# EasyEDA Pro project URADORRY-SUN.eprj, board Main/Rev1.0
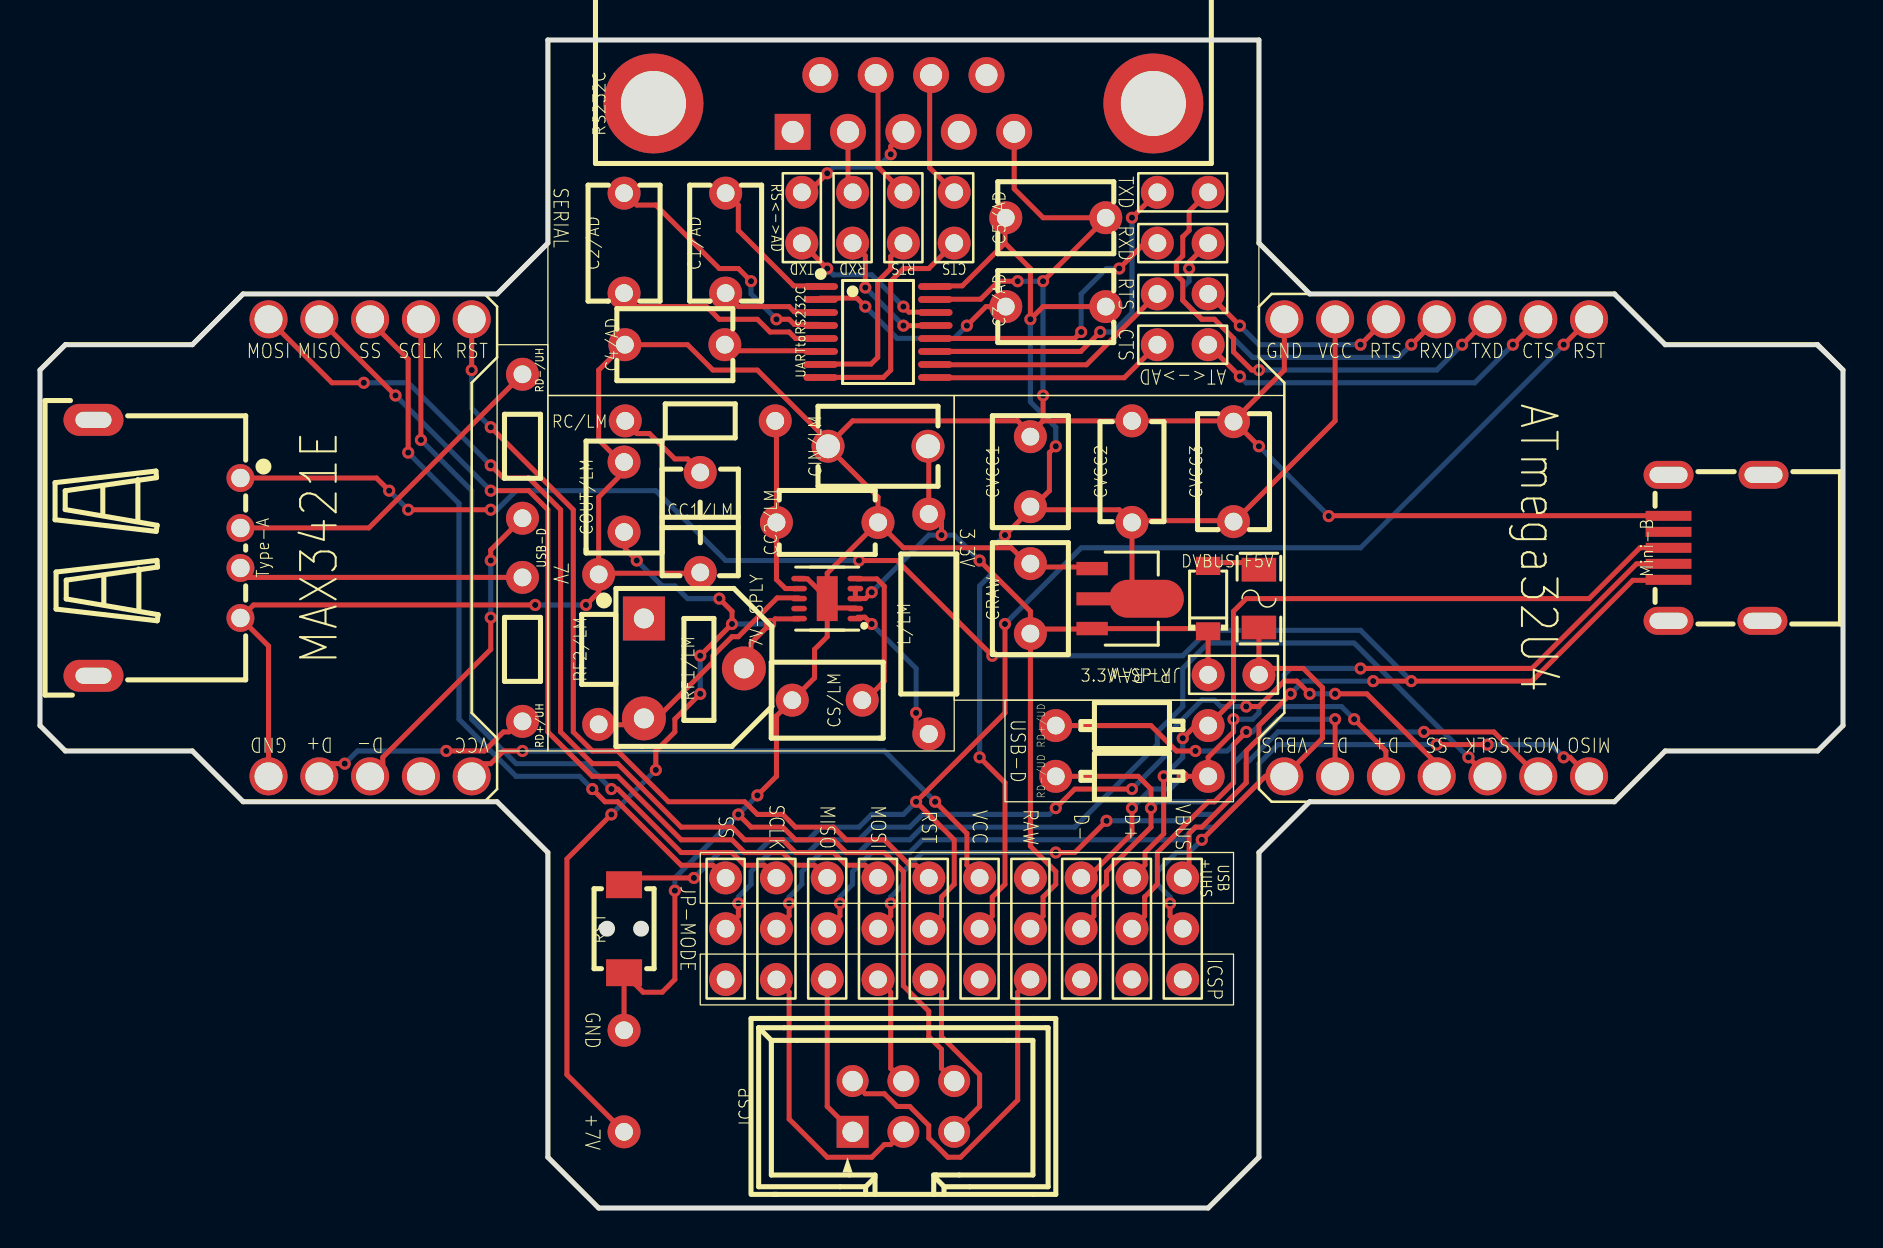
[diagram p6: board, top side]
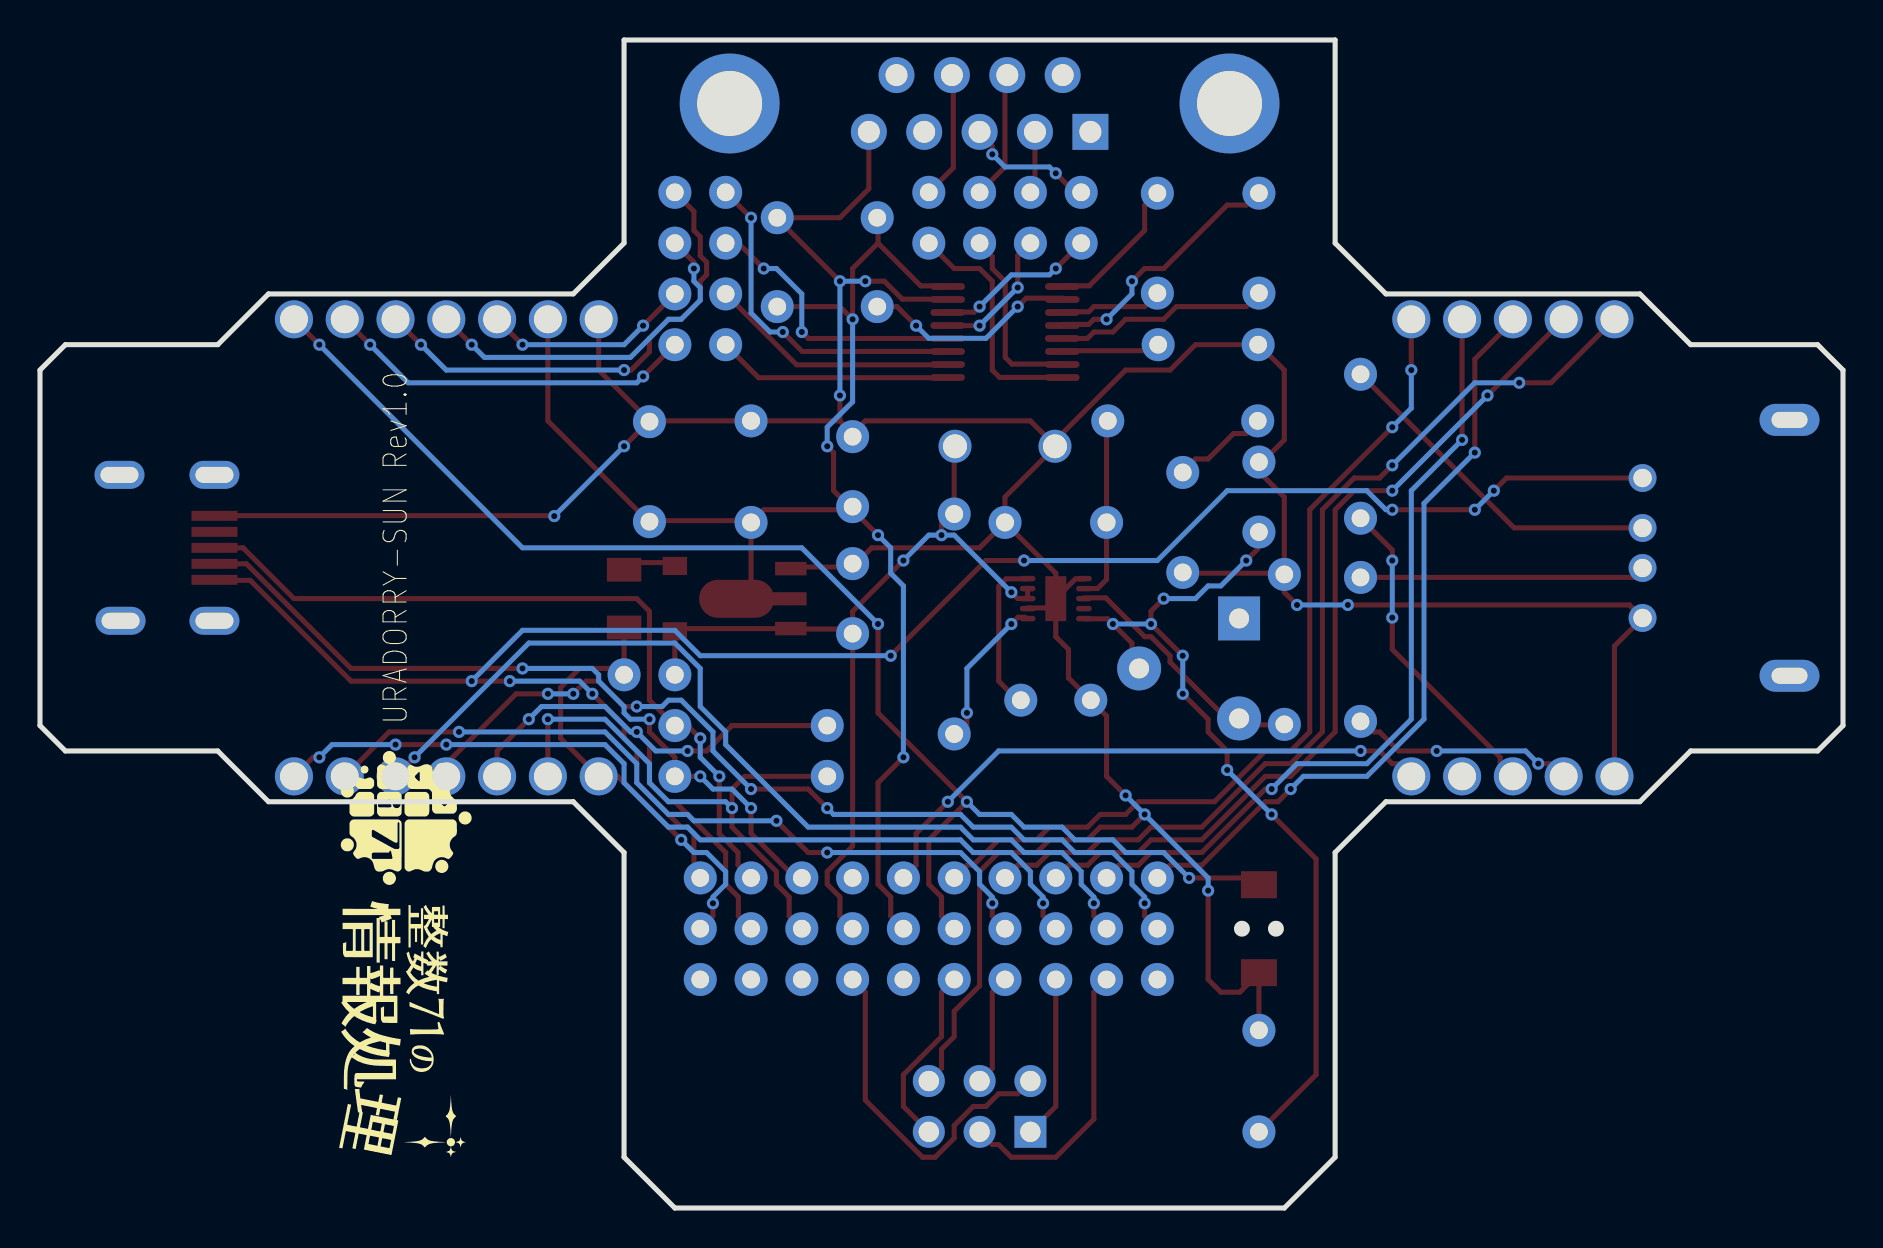
[diagram p7: board, bottom side, seen from below]

Outline 90.17 x 58.42 mm; copper layers: Top Layer, Bottom Layer. Coordinates in mm from the lower left corner of the outline.
Outline path: 0,41.91 1.27,43.18 7.62,43.18 10.16,45.72 22.86,45.72 25.4,48.26 25.4,58.42 60.96,58.42 60.96,48.26 63.5,45.72 78.74,45.72 81.28,43.18 88.9,43.18 90.17,41.91 90.17,24.13 88.9,22.86 81.28,22.86 78.74,20.32 63.5,20.32 60.96,17.78 60.96,2.54 58.42,0 27.94,0 25.4,2.54 25.4,17.78 22.86,20.32 10.16,20.32 7.62,22.86 1.27,22.86 0,24.13 0,41.91
Stack: Top Layer 0.035mm / Dielectric1 1.51mm FR4 er 4.5 / Bottom Layer 0.035mm

## Design rules (mm)
template: JLCPCB Capability(Two Layers Board)
spacing copperThickness1oz (default): track to track 0.102, other pairs 0.152 to 0.3
spacing copperThickness2oz: track to track 0.203, other pairs 0.152 to 0.3
track width copperThickness1oz (default): min 0.127, default 0.254, max 2.54
track width copperThickness2oz: min 0.203, default 0.254, max 2.54
differential pair differentialPair (default): width min 0.127, default 0.254, max 2.54; gap min 0.152, default 0.152
via viaSize (default): diameter min 0.5, default 0.61, max 10; hole min 0.3, default 0.305, max 6.3

## Placement (name value [footprint] x y rotation side)
3.3V-SPLY  AMS1117-3.3  [SOT-89-3L_L4.5-W2.5-P1.50-LS4.1-BR]  53.97 30.48 180 top
7V-SPLY  LM4510SD/NOPB  [VSON-10_L3.0-W3.0-P0.50-BL-EP-ADS8867IDRCR]  39.37 30.48 90 top
C1/AD  100nF  [cap-th_l5.8-w3.6-p5.0-d0.6]  34.29 48.26 90 top
C2/AD  100nF  [cap-th_l5.8-w3.6-p5.0-d0.6]  29.21 48.26 90 top
C3/AD  100nF  [cap-th_l5.8-w3.6-p5.0-d0.6]  50.8 45.09 180 top
C4/AD  100nF  [cap-th_l5.8-w3.6-p5.0-d0.6]  31.75 43.18 0 top
C5/AD  100nF  [cap-th_l5.8-w3.6-p5.0-d0.6]  50.8 49.53 0 top
CC1/LM  2.2nF  [cap-th_l5.0-w3.5-p5.00-d0.5]  33.02 34.29 270 top
CC2/LM  15pF  [cap-th_l4.8-w3.2-p5.08-d0.5]  39.37 34.29 0 top
CIN/LM  4.7uF  [cap-th_l6.0-w4.0-p5.00-d1.2]  41.91 38.1 180 top
COUT/LM  10uF  [cap-th_l5.5-w3.8-p3.50-d0.6]  29.21 35.56 90 top
CRAW  10uF  [cap-th_l5.5-w3.8-p3.50-d0.6]  49.53 30.48 90 top
CS/LM  10uF  [cap-th_l5.5-w3.8-p3.50-d0.6]  39.37 25.4 180 top
CVCC1  10uF  [cap-th_l5.5-w3.8-p3.50-d0.6]  49.53 36.83 90 top
CVCC2  1uF  [cap-th_l5.0-w3.2-p5.08-d0.6]  54.61 36.83 90 top
CVCC3  100nF  [cap-th_l5.8-w3.6-p5.0-d0.6]  59.69 36.83 90 top
DVBUS  MBR0540  [SOD-123_L2.7-W1.6-LS3.7-RD]  58.42 30.48 90 top
F5V  BSMD1206-150-16V  [F1206]  60.96 30.48 90 top
ICSP  FBH25401-D06S1001K6K  [IDC-TH_FBH25401-D06S1001K6K]  43.18 5.08 0 top
L/LM  4.7uH  [ind-th_bd2.8-l7.0-p11.00-d0.5]  44.45 29.21 270 top
Mini-B  GT-USB-2207  [USB-SMD_GT-USB-2207]  83.82 33.02 90 top
NOREF  -  [Pad_e108]  58.42 48.26 0 top
NOREF#2  -  [Pad_e168]  46.99 16.51 0 top
NOREF#3  -  [Pad_e162]  49.53 13.97 0 top
NOREF#4  -  [Pad_e195]  57.15 11.43 0 top
NOREF#5  -  [Pad_e657]  74.93 44.45 0 top
NOREF#6  -  [Pad_e655]  74.93 21.59 0 top
NOREF#7  -  [Pad_e157]  41.91 13.97 0 top
NOREF#8  -  [Pad_e924]  16.51 44.45 0 top
NOREF#9  -  [Pad_e854]  19.05 44.45 0 top
NOREF#10  -  [Pad_e146]  36.83 11.43 0 top
NOREF#11  -  [Pad_e113]  55.88 45.72 0 top
NOREF#12  -  [Pad_e448]  64.77 44.45 0 top
NOREF#13  -  [Pad_e193]  57.15 16.51 0 top
NOREF#14  -  [Pad_e122]  43.18 50.8 0 top
NOREF#15  -  [Pad_e170]  54.61 16.51 0 top
NOREF#16  -  [Pad_e3713]  29.21 3.81 0 top
NOREF#17  -  [Pad_e153]  54.61 11.43 0 top
NOREF#18  -  [Pad_e605]  72.39 44.45 0 top
NOREF#19  -  [Pad_e154]  34.29 13.97 0 top
NOREF#20  -  [Pad_e116]  40.64 50.8 0 top
NOREF#21  -  [Pad_e119]  45.72 48.26 0 top
NOREF#22  -  [Pad_e161]  54.61 13.97 0 top
NOREF#23  -  [Pad_e192]  57.15 13.97 0 top
NOREF#24  -  [Pad_e811]  21.59 21.59 0 top
NOREF#25  -  [Pad_e105]  55.88 48.26 0 top
NOREF#26  -  [Pad_e45]  58.42 26.67 0 top
NOREF#27  -  [Pad_e163]  34.29 16.51 0 top
NOREF#28  -  [Pad_e160]  52.07 13.97 0 top
NOREF#29  -  [Pad_e502]  67.31 21.59 0 top
NOREF#30  -  [Pad_e997]  13.97 44.45 0 top
NOREF#31  -  [Pad_e703]  77.47 21.59 0 top
NOREF#32  -  [Pad_e165]  39.37 16.51 0 top
NOREF#33  -  [Pad_e159]  46.99 13.97 0 top
NOREF#34  -  [Pad_e1001]  13.97 21.59 0 top
NOREF#35  -  [Pad_e167]  44.45 16.51 0 top
NOREF#36  -  [Pad_e169]  52.07 16.51 0 top
NOREF#37  -  [Pad_e1062]  11.43 21.59 0 top
NOREF#38  -  [Pad_e144]  34.29 11.43 0 top
NOREF#39  -  [Pad_e404]  62.23 21.59 0 top
NOREF#40  -  [Pad_e112]  58.42 43.18 0 top
NOREF#41  -  [Pad_e810]  21.59 44.45 0 top
NOREF#42  -  [Pad_e149]  44.45 11.43 0 top
NOREF#43  -  [Pad_e557]  69.85 44.45 0 top
NOREF#44  -  [Pad_e147]  39.37 11.43 0 top
NOREF#45  -  [Pad_e171]  49.53 16.51 0 top
NOREF#46  -  [Pad_e166]  41.91 16.51 0 top
NOREF#47  -  [Pad_e120]  45.72 50.8 0 top
NOREF#48  -  [Pad_e452]  64.77 21.59 0 top
NOREF#49  -  [Pad_e158]  44.45 13.97 0 top
NOREF#50  -  [Pad_e114]  58.42 45.72 0 top
NOREF#51  -  [Pad_e155]  36.83 13.97 0 top
NOREF#52  -  [Pad_e705]  77.47 44.45 0 top
NOREF#53  -  [Pad_e405]  62.23 44.45 0 top
NOREF#54  -  [Pad_e121]  43.18 48.26 0 top
NOREF#55  -  [Pad_e857]  19.05 21.59 0 top
NOREF#56  -  [Pad_e110]  58.42 50.8 0 top
NOREF#57  -  [Pad_e559]  69.85 21.59 0 top
NOREF#58  -  [Pad_e111]  55.88 43.18 0 top
NOREF#59  -  [Pad_e500]  67.31 44.45 0 top
NOREF#60  -  [Pad_e109]  55.88 50.8 0 top
NOREF#61  -  [Pad_e603]  72.39 21.59 0 top
NOREF#62  -  [Pad_e117]  38.1 48.26 0 top
NOREF#63  -  [Pad_e40]  60.96 26.67 0 top
NOREF#64  -  [Pad_e151]  49.53 11.43 0 top
NOREF#65  -  [Pad_e3708]  29.21 8.89 0 top
NOREF#66  -  [Pad_e164]  36.83 16.51 0 top
NOREF#67  -  [Pad_e922]  16.51 21.59 0 top
NOREF#68  -  [Pad_e152]  52.07 11.43 0 top
NOREF#69  -  [Pad_e148]  41.91 11.43 0 top
NOREF#70  -  [Pad_e156]  39.37 13.97 0 top
NOREF#71  -  [Pad_e115]  40.64 48.26 0 top
NOREF#72  -  [Pad_e118]  38.1 50.8 0 top
NOREF#73  -  [Pad_e1060]  11.43 44.45 0 top
NOREF#74  -  [Pad_e150]  46.99 11.43 0 top
RC/LM  47kΩ  [res-th_bd1.7-l3.5-p7.50-d0.5]  33.02 39.37 180 top
RD+/UD  22Ω  [res-th_bd2.3-l3.7-p7.70-d0.9]  54.61 24.13 0 top
RD+/UH  33Ω  [res-th_bd1.8-l3.2-p7.20-d0.4]  24.13 27.94 90 top
RD-/UD  22Ω  [res-th_bd2.3-l3.7-p7.70-d0.9]  54.61 21.59 0 top
RD-/UH  33Ω  [res-th_bd1.8-l3.2-p7.20-d0.4]  24.13 38.1 90 top
RF1/LM  100kΩ  [RES-ADJ-SMD_RM065-V1]  32.7 26.99 270 top
RF2/LM  20kΩ  [res-th_bd1.7-l3.5-p7.50-d0.5]  27.94 27.94 90 top
RS232C  D-SUB-DR-9PCM-CB  [DB9-TH_ID09S33E4GV00LF]  43.18 55.25 180 top
RST  YTSA010A0201803B  [SW-SMD_L4.0-W3.0-LS5.0-EH]  29.21 13.97 90 top
Type-A  KH-AF90QC-10-H6.3  [USB-A-TH_KINGHELM_KH-AF90QC-10-H6.3]  6.35 33.02 270 top
UARTtoRS232C  ADM3202ARUZ-REEL7  [TSSOP-16_L5.0-W4.4-P0.65-LS6.4-BL]  41.91 43.82 270 top

## Footprints (pads in the part's own frame, mm; a bottom-side part is the same pattern mirrored in y, then rotated)
cap-th_l4.8-w3.2-p5.08-d0.5
  round 1.651 hole 0.9x0.889: 1(-2.54,0) 2(2.54,0)
cap-th_l5.0-w3.2-p5.08-d0.6
  round 1.651 hole 0.9x0.889: 1(-2.54,0) 2(2.54,0)
cap-th_l5.0-w3.5-p5.00-d0.5
  round 1.651 hole 0.889: 1(-2.5,0) 2(2.5,0)
cap-th_l5.5-w3.8-p3.50-d0.6
  round 1.651 hole 0.889: 1(-1.75,0) 2(1.75,0)
cap-th_l5.8-w3.6-p5.0-d0.6
  round 1.651 hole 0.889: 1(-2.5,0) 2(2.5,0)
cap-th_l6.0-w4.0-p5.00-d1.2
  round 1.651 hole 1.2x0.889: 1(-2.5,0) 2(2.5,0)
DB9-TH_ID09S33E4GV00LF
  rect 1.8x1.8 hole 1.1: 1(5.54,1.42)
  round 1.8 hole 1.1: 2(2.77,1.42) 3(0,1.42) 4(-2.77,1.42) 5(-5.54,1.42) 6(4.155,-1.42) 7(1.385,-1.42) 8(-1.385,-1.42) 9(-4.155,-1.42)
  round 5 hole 3.25: 10(-12.5,0) 11(12.5,0)
F1206
  rect 1.19x1.728 smd: 1(-1.445,0) 2(1.445,0)
IDC-TH_FBH25401-D06S1001K6K
  rect 1.6x1.6 hole 1.02: 1(-2.54,-1.27)
  round 1.6 hole 1.02: 2(-2.54,1.27) 3(0,-1.27) 4(0,1.27) 5(2.54,-1.27) 6(2.54,1.27)
ind-th_bd2.8-l7.0-p11.00-d0.5
  round 1.651 hole 0.9x0.889: 1(-5.5,0) 2(5.5,0)
Pad_e40
  round 1.651 hole 0.889: 1(0,0)
Pad_e45
  round 1.651 hole 0.889: 1(0,0)
Pad_e105
  round 1.651 hole 0.889: 2(0,0)
Pad_e108
  round 1.651 hole 0.889: 2(0,0)
Pad_e109
  round 1.651 hole 0.889: 2(0,0)
Pad_e110
  round 1.651 hole 0.889: 2(0,0)
Pad_e111
  round 1.651 hole 0.889: 2(0,0)
Pad_e112
  round 1.651 hole 0.889: 2(0,0)
Pad_e113
  round 1.651 hole 0.889: 2(0,0)
Pad_e114
  round 1.651 hole 0.889: 2(0,0)
Pad_e115
  round 1.651 hole 0.889: 2(0,0)
Pad_e116
  round 1.651 hole 0.889: 2(0,0)
Pad_e117
  round 1.651 hole 0.889: 2(0,0)
Pad_e118
  round 1.651 hole 0.889: 2(0,0)
Pad_e119
  round 1.651 hole 0.889: 2(0,0)
Pad_e120
  round 1.651 hole 0.889: 2(0,0)
Pad_e121
  round 1.651 hole 0.889: 2(0,0)
Pad_e122
  round 1.651 hole 0.889: 2(0,0)
Pad_e144
  round 1.651 hole 0.889: 3(0,0)
Pad_e146
  round 1.651 hole 0.889: 3(0,0)
Pad_e147
  round 1.651 hole 0.889: 3(0,0)
Pad_e148
  round 1.651 hole 0.889: 3(0,0)
Pad_e149
  round 1.651 hole 0.889: 3(0,0)
Pad_e150
  round 1.651 hole 0.889: 3(0,0)
Pad_e151
  round 1.651 hole 0.889: 3(0,0)
Pad_e152
  round 1.651 hole 0.889: 3(0,0)
Pad_e153
  round 1.651 hole 0.889: 3(0,0)
Pad_e154
  round 1.651 hole 0.889: 3(0,0)
Pad_e155
  round 1.651 hole 0.889: 3(0,0)
Pad_e156
  round 1.651 hole 0.889: 3(0,0)
Pad_e157
  round 1.651 hole 0.889: 3(0,0)
Pad_e158
  round 1.651 hole 0.889: 3(0,0)
Pad_e159
  round 1.651 hole 0.889: 3(0,0)
Pad_e160
  round 1.651 hole 0.889: 3(0,0)
Pad_e161
  round 1.651 hole 0.889: 3(0,0)
Pad_e162
  round 1.651 hole 0.889: 3(0,0)
Pad_e163
  round 1.651 hole 0.889: 3(0,0)
Pad_e164
  round 1.651 hole 0.889: 3(0,0)
Pad_e165
  round 1.651 hole 0.889: 3(0,0)
Pad_e166
  round 1.651 hole 0.889: 3(0,0)
Pad_e167
  round 1.651 hole 0.889: 3(0,0)
Pad_e168
  round 1.651 hole 0.889: 3(0,0)
Pad_e169
  round 1.651 hole 0.889: 3(0,0)
Pad_e170
  round 1.651 hole 0.889: 3(0,0)
Pad_e171
  round 1.651 hole 0.889: 3(0,0)
Pad_e192
  round 1.651 hole 0.889: 3(0,0)
Pad_e193
  round 1.651 hole 0.889: 3(0,0)
Pad_e195
  round 1.651 hole 0.889: 3(0,0)
Pad_e404
  round 1.905 hole 1.397: 1(0,0)
Pad_e405
  round 1.905 hole 1.397: 1(0,0)
Pad_e448
  round 1.905 hole 1.397: 1(0,0)
Pad_e452
  round 1.905 hole 1.397: 1(0,0)
Pad_e500
  round 1.905 hole 1.397: 1(0,0)
Pad_e502
  round 1.905 hole 1.397: 1(0,0)
Pad_e557
  round 1.905 hole 1.397: 1(0,0)
Pad_e559
  round 1.905 hole 1.397: 1(0,0)
Pad_e603
  round 1.905 hole 1.397: 1(0,0)
Pad_e605
  round 1.905 hole 1.397: 1(0,0)
Pad_e655
  round 1.905 hole 1.397: 1(0,0)
Pad_e657
  round 1.905 hole 1.397: 1(0,0)
Pad_e703
  round 1.905 hole 1.397: 1(0,0)
Pad_e705
  round 1.905 hole 1.397: 1(0,0)
Pad_e810
  round 1.905 hole 1.397: 1(0,0)
Pad_e811
  round 1.905 hole 1.397: 1(0,0)
Pad_e854
  round 1.905 hole 1.397: 1(0,0)
Pad_e857
  round 1.905 hole 1.397: 1(0,0)
Pad_e922
  round 1.905 hole 1.397: 1(0,0)
Pad_e924
  round 1.905 hole 1.397: 1(0,0)
Pad_e997
  round 1.905 hole 1.397: 1(0,0)
Pad_e1001
  round 1.905 hole 1.397: 1(0,0)
Pad_e1060
  round 1.905 hole 1.397: 1(0,0)
Pad_e1062
  round 1.905 hole 1.397: 1(0,0)
Pad_e3708
  round 1.651 hole 0.889: 4(0,0)
Pad_e3713
  round 1.651 hole 0.889: 5(0,0)
RES-ADJ-SMD_RM065-V1
  rect 2.2x2.1 hole 1: 1(-2.5,-2.5)
  round 2.2 hole 1: 2(0,2.5) 3(2.5,-2.5)
res-th_bd1.7-l3.5-p7.50-d0.5
  round 1.651 hole 0.889: 1(-3.75,0) 2(3.75,0)
res-th_bd1.8-l3.2-p7.20-d0.4
  round 1.651 hole 0.889: 1(-3.6,0) 2(3.6,0)
res-th_bd2.3-l3.7-p7.70-d0.9
  round 1.651 hole 0.889: 1(-3.81,0) 2(3.81,0)
SOD-123_L2.7-W1.6-LS3.7-RD
  rect 0.91x1.22 smd: 1(-1.635,0) 2(1.635,0)
SOT-89-3L_L4.5-W2.5-P1.50-LS4.1-BR
  rect 1.575x0.672 smd: 1(1.356,-1.5) 3(1.356,1.5)
  custom 5.377x1.9 smd: 2(-1.356,0.009)
SW-SMD_L4.0-W3.0-LS5.0-EH
  rect 1.35x1.8 smd: 1(-2.2,0) 2(2.2,0)
TSSOP-16_L5.0-W4.4-P0.65-LS6.4-BL
  oval 0.343x1.732 smd: 1(-2.275,-2.866) 2(-1.625,-2.866) 3(-0.975,-2.866) 4(-0.325,-2.866) 5(0.325,-2.866) 6(0.975,-2.866) 7(1.625,-2.866) 8(2.275,-2.866) 9(2.275,2.866) 10(1.625,2.866) 11(0.975,2.866) 12(0.325,2.866) 13(-0.325,2.866) 14(-0.975,2.866) 15(-1.625,2.866) 16(-2.275,2.866)
USB-A-TH_KINGHELM_KH-AF90QC-10-H6.3
  round 1.4 hole 0.92: 1(-3.491,3.675) 2(-0.992,3.675) 3(1.008,3.675) 4(3.509,3.675)
  oval 1.6x3 hole 0.8x1.8: 5(-6.4,-3.675) 6(6.4,-3.675)
USB-SMD_GT-USB-2207
  rect 0.5x2.3 smd: 1(-1.6,2.375) 2(-0.8,2.375) 3(0,2.375) 4(0.8,2.375) 5(1.6,2.375)
  oval 1.4x2.5 hole 0.8x1.9: 6(-3.65,2.375) 7(3.65,2.375) 8(-3.65,-2.321) 9(3.65,-2.375)
VSON-10_L3.0-W3.0-P0.50-BL-EP-ADS8867IDRCR
  oval 0.28x0.787 smd: 1(-1,-1.407) 2(-0.5,-1.407) 3(0,-1.407) 4(0.5,-1.407) 5(1,-1.407) 6(1,1.407) 7(0.5,1.407) 8(0,1.407) 9(-0.5,1.407) 10(-1,1.407)
  rect 2.25x1.05 smd: 11(0,0)

## Nets
+3.3V: 3.3V-SPLY.2 C3/AD.1 C5/AD.1 CVCC1.1 CVCC2.1 CVCC3.1 NOREF#12.1 NOREF#33.3 UARTtoRS232C.16
+5V: F5V.1 NOREF#23.3 NOREF#39.1 NOREF#63.1
+5V-SAT: DVBUS.2 F5V.2
+7V: 7V-SPLY.10 COUT/LM.1 NOREF#16.5 RF1/LM.2
GND: 3.3V-SPLY.1 7V-SPLY.2 7V-SPLY.6 7V-SPLY.11 C4/AD.1 C5/AD.2 CC1/LM.2 CC2/LM.2 CIN/LM.2 COUT/LM.2 CRAW.2 CS/LM.2 CVCC1.2 CVCC2.2 CVCC3.2 ICSP.6 Mini-B.5 NOREF#37.1 NOREF#53.1 NOREF#65.4 RF2/LM.2 RS232C.5 RST.1 Type-A.4 UARTtoRS232C.15
+3.3V/MX: NOREF#2.3 NOREF#24.1
+5V/U: Mini-B.1 NOREF#13.3 Type-A.1
C1+/AD: C1/AD.2 UARTtoRS232C.1
C1-/AD: C1/AD.1 UARTtoRS232C.3
C2+/AD: C2/AD.2 UARTtoRS232C.4
C2-/AD: C2/AD.1 UARTtoRS232C.5
COMP1/LM: CC1/LM.1 RC/LM.2
COMP/LM: 7V-SPLY.7 CC2/LM.1 RC/LM.1
CTS-AT/AD: NOREF#58.2 UARTtoRS232C.9
CTS-RS/AD: NOREF#21.2 UARTtoRS232C.8
CTS/AT: NOREF#5.1 NOREF#40.2
CTS/RS: NOREF#47.2 RS232C.8
D+/AT: NOREF#22.3 NOREF#29.1 RD+/UD.1
D+/MX: NOREF#34.1 RD+/UH.1
D+/UD: Mini-B.3 NOREF#15.3 RD+/UD.2
D+/UH: RD+/UH.2 Type-A.3
D-/AT: NOREF#28.3 NOREF#48.1 RD-/UD.1
D-/MX: NOREF#67.1 RD-/UH.1
D-/UD: Mini-B.2 NOREF#36.3 RD-/UD.2
D-/UH: RD-/UH.2 Type-A.2
DCD/RS: RS232C.1
DSR/RS: RS232C.6
DTR/RS: RS232C.4
FB/LM: 7V-SPLY.8 RF1/LM.3 RF2/LM.1
MISO/AT: NOREF#31.1 NOREF#70.3
MISO/IC: ICSP.1 NOREF#44.3
MISO/MX: NOREF#30.1 NOREF#32.3
MOSI/AT: NOREF#6.1 NOREF#7.3
MOSI/IC: ICSP.4 NOREF#69.3
MOSI/MX: NOREF#46.3 NOREF#73.1
RAW: 3.3V-SPLY.3 7V-SPLY.3 7V-SPLY.4 CIN/LM.1 CRAW.1 DVBUS.1 L/LM.1 NOREF#3.3 NOREF#26.1
RAW/IC: ICSP.2 NOREF#64.3
RING/RS: RS232C.9
RST: NOREF#49.3 NOREF#52.1 RST.2
RST/IC: ICSP.5 NOREF#42.3
RST/MX: NOREF#35.3 NOREF#41.1
RTS-AT/AD: NOREF#11.2 UARTtoRS232C.10
RTS-RS/AD: NOREF#54.2 UARTtoRS232C.7
RTS/AT: NOREF#50.2 NOREF#59.1
RTS/RS: NOREF#14.2 RS232C.7
RXD-AT/AD: NOREF#25.2 UARTtoRS232C.12
RXD-RS/AD: NOREF#71.2 UARTtoRS232C.13
RXD/AT: NOREF.2 NOREF#43.1
RXD/RS: NOREF#20.2 RS232C.2
SCLK/AT: NOREF#51.3 NOREF#61.1
SCLK/IC: ICSP.3 NOREF#10.3
SCLK/MX: NOREF#9.1 NOREF#66.3
SS/AT: NOREF#19.3 NOREF#57.1
SS/LM: 7V-SPLY.5 CS/LM.1
SS/MX: NOREF#8.1 NOREF#27.3
SW/LM: 7V-SPLY.1 L/LM.2
TXD-AT/AD: NOREF#60.2 UARTtoRS232C.11
TXD-RS/AD: NOREF#62.2 UARTtoRS232C.14
TXD/AT: NOREF#18.1 NOREF#56.2
TXD/RS: NOREF#72.2 RS232C.3
V+/AD: C3/AD.2 UARTtoRS232C.2
V-/AD: C4/AD.2 UARTtoRS232C.6

Pads without a net: 7V-SPLY 9; Mini-B 4 6 7 8 9; NOREF#4 3; NOREF#17 3; NOREF#38 3; NOREF#45 3; NOREF#55 1; NOREF#68 3; NOREF#74 3; RF1/LM 1; RS232C 10 11; Type-A 5 6

## Via types
v1: diameter 0.61, hole 0.305, Top Layer to Bottom Layer, 106 vias

## Routing (per net, layer and track width the routed paths; a pad name or vN(x,y) marks a point on that pad's centre or on a via; arc(x,y) is an arc through that point)
+3.3V: length 74.5
  Top Layer w0.254: v1(46.99,22.54) 48.26,21.27 48.26,16.19 47.62,15.56 47.62,14.61 NOREF#33.3 ; 48.26,48.26 49.53,46.99 v1(49.53,44.45) 50.17,45.09 53.34,45.09 ; 48.26,48.26 48.26,49.53 ; 48.26,48.26 46.12,46.12 44.83,46.12 ; CVCC2.1 53.97,34.93 49.53,34.93 ; CVCC2.1 54.61,31.12 55.25,30.48 ; CVCC2.1 54.66,34.34 54.66,34.38 59.65,34.38 59.69,34.34 ; 49.53,34.93 50.48,35.88 50.48,37.78 v1(50.8,38.1) ; 49.53,34.93 v1(48.26,33.66) ; 59.69,34.29 64.77,39.37 NOREF#12.1
  Bottom Layer w0.254: v1(49.53,44.45) 49.53,40.32 50.8,39.05 v1(50.8,38.1) ; v1(46.99,22.54) 46.99,31.12 47.62,31.75 47.62,33.02 v1(48.26,33.66)
+5V: length 23.2
  Top Layer w0.254: v1(58.1,18.42) 61.28,21.59 NOREF#39.1 64.14,23.5 64.14,26.04 63.18,26.99 61.28,26.99 NOREF#63.1 60.96,29.21 ; v1(56.52,15.24) 56.52,14.61 NOREF#23.3
  Bottom Layer w0.254: v1(56.52,15.24) 56.52,15.56 55.88,16.19 55.88,16.83 56.83,17.78 57.47,17.78 v1(58.1,18.42)
+5V-SAT: length 2.8
  Top Layer w0.254: 58.38,32.28 60.43,32.28 60.96,31.75
+7V: length 44
  Top Layer w0.254: 35.23,27.12 35.56,27.45 35.56,28.26 v1(36.51,29.21) 36.77,29.47 37.93,29.47 ; v1(33.02,27.62) v1(34.61,29.21) 34.61,29.85 v1(33.97,30.48) ; v1(29.84,32.39) 29.28,32.95 29.28,33.69 ; v1(30.8,21.91) 30.8,22.86 31.75,23.81 31.75,24.45 v1(33.02,25.72) ; v1(28.58,19.69) 26.35,17.46 26.35,6.67 NOREF#16.5
  Bottom Layer w0.254: v1(36.51,29.21) v1(34.61,29.21) ; v1(30.8,21.91) v1(28.58,19.69) ; v1(33.97,30.48) 32.39,30.48 31.75,31.12 31.12,31.12 v1(29.84,32.39) ; v1(33.02,25.72) v1(33.02,27.62)
GND: length 208.2
  Top Layer w0.254: v1(34.93,19.69) 35.56,19.05 37.15,19.05 37.78,18.42 39.69,18.42 40.32,17.78 42.23,17.78 43.18,16.83 43.18,11.11 44.45,9.84 44.45,8.57 45.09,7.94 45.09,6.99 ICSP.6 ; 7V-SPLY.11 38.39,31.47 37.97,31.47 ; 7V-SPLY.11 39.37,31.75 CC2/LM.2 ; 7V-SPLY.11 39.84,30.02 40.78,30.02 ; 7V-SPLY.11 39.37,28.58 38.74,27.94 38.74,26.52 CS/LM.2 36.83,24.61 36.83,21.59 v1(35.88,20.64) ; v1(31.75,15.88) 31.75,11.43 31.12,10.8 30.16,10.8 29.21,11.75 ; CC2/LM.2 41.91,35.56 39.37,38.1 ; CC2/LM.2 43.18,33.02 48.58,33.02 49.21,32.39 49.53,32.39 49.85,32.06 52.64,32.06 ; NOREF#65.4 29.21,11.43 ; 33.02,31.75 27.94,31.75 ; 27.94,31.75 27.94,30.8 v1(27.31,30.16) ; 27.94,31.75 27.94,35.56 29.21,36.83 ; 39.37,38.1 39.37,38.42 35.88,41.91 33.66,41.91 32.39,43.18 29.4,43.18 29.3,43.28 ; 39.37,38.1 40.64,39.37 48.9,39.37 49.53,38.74 50.17,39.37 ; 10.03,29.51 11.43,28.11 NOREF#37.1 ; 10.03,29.51 10.01,29.49 ; 10.03,29.51 9.98,29.55 ; 10.03,29.51 10.68,30.16 v1(24.77,30.16) ; 81.44,34.63 64.47,34.63 v1(64.45,34.61) ; 50.17,39.37 CVCC2.2 59.69,39.37 ; 50.17,39.37 v1(50.17,40.64) ; NOREF#53.1 62.23,41.91 59.69,39.37 ; v1(50.17,46.36) 53.34,49.53 ; RS232C.5 48.72,50.98 50.17,49.53 C5/AD.2 ; v1(48.9,46.36) 47.94,46.36 47.04,45.46 44.82,45.46 ; 29.21,43.18 27.94,41.91 27.94,38.42 28.89,37.47 29.21,37.47 ; 59.69,39.37 v1(60.96,38.1)
  Bottom Layer w0.254: v1(35.88,20.64) v1(34.93,19.69) 31.75,16.51 v1(31.75,15.88) ; v1(64.45,34.61) v1(60.96,38.1) ; v1(48.9,46.36) v1(50.17,46.36) v1(50.17,40.64) ; v1(24.77,30.16) v1(27.31,30.16)
+3.3V/MX: length 29.5
  Top Layer w0.254: v1(24.13,22.86) 23.18,22.86 22.54,22.23 22.14,22.23 21.59,21.67 ; v1(44.77,20.32) 46.36,18.73 46.36,17.15 NOREF#2.3
  Bottom Layer w0.254: v1(24.13,22.86) 42.23,22.86 v1(44.77,20.32)
+5V/U: length 97.6
  Top Layer w0.254: v1(47.62,27.62) 42.86,32.39 v1(40.96,32.39) ; v1(66.68,26.35) v1(68.58,26.35) 74.61,26.35 79.65,31.39 81.53,31.39 ; Type-A.1 16.83,36.51 v1(17.46,35.88) ; v1(62.55,25.72) 60.96,24.13 60.96,23.5 60.33,22.86 60.33,21.27 58.1,19.05 57.78,19.05 57.47,18.73 57.47,16.83 NOREF#13.3 ; v1(22.54,34.93) v1(18.42,34.93)
  Bottom Layer w0.254: v1(66.68,26.35) 63.18,26.35 v1(62.55,25.72) ; v1(68.58,26.35) 66.04,28.89 58.42,28.89 57.15,27.62 v1(47.62,27.62) ; v1(22.54,34.93) 22.86,34.93 23.81,35.88 30.8,35.88 34.29,32.39 v1(40.96,32.39) ; v1(17.46,35.88) v1(18.42,34.93)
C1+/AD: length 7.5
  Top Layer w0.254: 34.29,50.8 34.93,50.17 34.93,48.9 37.7,46.12 39.06,46.12
C1-/AD: length 5.1
  Top Layer w0.254: 38.99,44.82 37.73,44.82 37.47,45.09 34.93,45.09 34.29,45.72
C2+/AD: length 12.9
  Top Layer w0.254: 29.21,50.8 29.84,50.17 30.8,50.17 33.97,46.99 34.93,46.99 v1(35.56,46.36) ; v1(36.83,44.45) 37.47,44.45 37.72,44.19 39.01,44.19
  Bottom Layer w0.254: v1(36.83,44.45) 35.56,45.72 v1(35.56,46.36)
C2-/AD: length 10.6
  Top Layer w0.254: 38.88,43.49 37.79,43.49 37.47,43.82 36.51,43.82 35.88,44.45 33.97,44.45 33.34,45.09 29.84,45.09 29.21,45.72
COMP1/LM: length 4.9
  Top Layer w0.254: 29.21,39.37 29.84,38.74 30.48,38.74 31.75,37.47 32.39,37.47 33.02,36.83
COMP/LM: length 9.2
  Top Layer w0.254: 37.91,30.98 37.28,30.98 36.83,31.43 CC2/LM.1 36.83,39.37
CTS-AT/AD: length 11.8
  Top Layer w0.254: 44.76,41.53 54.23,41.53 NOREF#58.2
CTS-RS/AD: length 12
  Top Layer w0.254: NOREF#21.2 44.45,46.99 43.18,46.99 42.55,46.36 42.55,41.91 42.18,41.54 39.13,41.54
CTS/AT: length 18.6
  Top Layer w0.254: v1(60.01,41.59) NOREF#40.2 ; NOREF#5.1 v1(73.66,43.18)
  Bottom Layer w0.254: v1(73.66,43.18) 71.75,41.28 60.33,41.28 v1(60.01,41.59)
CTS/RS: length 6.3
  Top Layer w0.254: NOREF#47.2 44.49,52.03 44.49,56.6
D+/AT: length 32.5
  Top Layer w0.254: NOREF#29.1 67.31,22.86 v1(65.72,24.45) ; v1(60.33,23.81) 59.69,23.18 59.69,21.27 58.74,20.32 58.42,20.32 55.88,17.78 55.88,16.19 55.25,15.56 55.25,14.61 NOREF#22.3 ; v1(57.78,22.86) 56.83,22.86 55.56,24.13 RD+/UD.1
  Bottom Layer w0.254: v1(65.72,24.45) 65.09,25.08 61.91,25.08 60.64,23.81 v1(60.33,23.81) 59.37,22.86 v1(57.78,22.86)
D+/MX: length 11.2
  Top Layer w0.254: v1(15.24,22.23) 14.61,22.23 NOREF#34.1 ; v1(20.32,22.86) 22.22,22.86 23.18,23.81 23.45,23.81 23.98,24.34
  Bottom Layer w0.254: v1(20.32,22.86) 15.88,22.86 v1(15.24,22.23)
D+/UD: length 38.7
  Top Layer w0.254: 81.28,33.02 80.01,33.02 77.47,30.48 60.33,30.48 59.69,29.85 59.69,25.4 RD+/UD.2 57.78,24.13 v1(57.15,23.5) ; v1(56.2,21.59) 56.2,18.72 55.26,17.78 55.26,17.16 NOREF#15.3
  Bottom Layer w0.254: v1(57.15,23.5) 57.15,22.54 v1(56.2,21.59)
D+/UH: length 14.3
  Top Layer w0.254: 10.04,31.94 10.44,31.54 RD+/UH.2
D-/AT: length 27.9
  Top Layer w0.254: NOREF#48.1 v1(64.77,24.45) ; RD-/UD.1 54.93,21.59 55.56,20.96 v1(55.56,20) 55.56,19.05 53.34,16.83 53.34,16.19 52.71,15.56 52.71,14.61 NOREF#28.3
  Bottom Layer w0.254: v1(64.77,24.45) 61.91,24.45 59.69,22.23 59.69,21.27 58.74,20.32 55.88,20.32 v1(55.56,20)
D-/MX: length 16.1
  Top Layer w0.254: NOREF#67.1 17.15,22.23 17.15,22.54 22.54,27.94 v1(22.54,29.53) ; RD-/UH.1 22.54,32.91 v1(22.54,32.39)
  Bottom Layer w0.254: v1(22.54,32.39) v1(22.54,29.53)
D-/UD: length 37.9
  Top Layer w0.254: v1(54.61,20) 54.61,18.73 52.39,16.51 NOREF#36.3 ; v1(57.15,21.59) RD-/UD.2 58.42,22.54 59.69,23.81 v1(59.69,24.45) ; v1(66.04,26.99) 74.61,26.99 79.84,32.22 Mini-B.2
  Bottom Layer w0.254: v1(66.04,26.99) 62.55,26.99 62.23,26.67 62.23,26.35 60.96,25.08 60.96,24.77 60.64,24.45 v1(59.69,24.45) ; v1(54.61,20) 55.56,20.96 56.52,20.96 v1(57.15,21.59)
D-/UH: length 17.4
  Top Layer w0.254: 9.96,34.02 16.45,34.02 RD-/UH.2
FB/LM: length 12.8
  Top Layer w0.254: 27.96,24.17 29.88,24.17 30.48,24.77 31.12,24.77 33.66,27.31 33.66,27.62 34.61,28.58 34.93,28.58 36.87,30.52 37.93,30.52
MISO/AT: length 44.1
  Top Layer w0.254: v1(69.85,23.18) v1(72.39,23.18) ; NOREF#31.1 76.52,22.54 v1(76.2,22.54) ; v1(40,15.24) 40,14.61 NOREF#70.3
  Bottom Layer w0.254: v1(72.39,23.18) 75.56,23.18 v1(76.2,22.54) ; v1(40,15.24) 40,15.56 40.64,16.19 40.64,16.83 41.59,17.78 43.5,17.78 44.13,18.42 57.15,18.42 57.78,19.05 58.74,19.05 60.96,21.27 60.96,22.23 61.91,23.18 v1(69.85,23.18)
MISO/IC: length 8.1
  Top Layer w0.254: ICSP.1 39.37,5.08 NOREF#44.3
MISO/MX: length 43.5
  Top Layer w0.254: NOREF#30.1 v1(17.78,40.64) ; v1(22.54,35.88) 24.45,35.88 25.4,34.93 25.4,23.81 27.62,21.59 28.89,21.59 32.07,18.42 34.61,18.42 35.24,17.78 37.15,17.78 37.78,17.15 38.74,17.15 NOREF#32.3
  Bottom Layer w0.254: v1(22.54,35.88) v1(17.78,40.64)
MOSI/AT: length 39.5
  Top Layer w0.254: v1(42.55,15.24) 42.55,14.61 NOREF#7.3 ; NOREF#6.1 72.71,23.81 v1(69.22,23.81) ; v1(50.8,17.78) 51.75,17.78 v1(53.34,19.37)
  Bottom Layer w0.254: v1(50.8,17.78) 44.13,17.78 43.18,16.83 43.18,16.19 42.55,15.56 v1(42.55,15.24) ; v1(53.34,19.37) 57.47,19.37 57.78,19.69 58.74,19.69 60.33,21.27 60.33,22.23 61.91,23.81 v1(69.22,23.81)
MOSI/IC: length 5.6
  Top Layer w0.254: NOREF#69.3 42.55,10.8 42.55,6.99 ICSP.4
MOSI/MX: length 48.6
  Top Layer w0.254: NOREF#46.3 41.28,17.15 40.32,17.15 39.69,17.78 37.78,17.78 37.15,18.42 35.24,18.42 34.61,19.05 32.07,19.05 28.89,22.23 27.62,22.23 26.03,23.81 26.03,34.93 24.45,36.51 23.18,36.51 v1(22.54,37.15) ; v1(16.19,41.28) 14.61,41.28 NOREF#73.1
  Bottom Layer w0.254: v1(22.54,37.15) 18.42,41.28 v1(16.19,41.28)
RAW: length 44.6
  Top Layer w0.254: 49.53,28.58 49.53,18.1 50.8,16.83 50.8,16.19 50.17,15.56 50.17,14.61 NOREF#3.3 ; 49.53,28.58 49.53,29.85 v1(46.99,32.39) ; 49.53,28.58 49.91,28.96 52.69,28.96 ; NOREF#26.1 58.42,28.58 ; 58.43,28.89 58.33,28.98 3.3V-SPLY.3 ; 7V-SPLY.3 40.78,30.97 40.8,31 ; v1(45.09,33.66) 45.09,34.29 44.45,34.93 44.45,38.1 ; 41.03,30.48 41.28,30.48 v1(41.59,30.8)
  Bottom Layer w0.254: v1(41.59,30.8) 44.45,33.66 v1(45.09,33.66) 45.72,33.66 v1(46.99,32.39)
RAW/IC: length 17.7
  Top Layer w0.254: NOREF#64.3 48.9,10.8 48.9,5.4 46.04,2.54 45.4,2.54 44.45,3.49 44.45,4.13 43.5,5.08 42.86,5.08 42.23,5.72 41.28,5.72 ICSP.2
RST: length 70.1
  Top Layer w0.254: v1(48.26,29.21) 48.26,24.77 v1(43.81,20.32) 45.72,18.42 45.72,16.19 45.09,15.56 45.09,14.61 NOREF#49.3 ; v1(32.7,16.51) 29.21,16.51 ; NOREF#52.1 v1(76.2,43.18)
  Bottom Layer w0.254: v1(76.2,43.18) 66.04,33.02 52.07,33.02 v1(48.26,29.21) ; v1(43.81,20.32) 43.18,19.69 41.59,19.69 40.96,19.05 39.05,19.05 38.42,18.42 36.51,18.42 35.88,17.78 33.97,17.78 v1(32.7,16.51)
RST/IC: length 9.2
  Top Layer w0.254: NOREF#42.3 45.09,10.8 45.09,8.57 46.99,6.67 46.99,5.08 ICSP.5
RST/MX: length 43.5
  Top Layer w0.254: v1(22.54,39.05) 26.67,34.93 26.67,23.81 27.62,22.86 28.89,22.86 31.43,20.32 35.24,20.32 35.88,19.69 37.15,19.69 37.78,19.05 39.69,19.05 40.32,18.42 42.23,18.42 43.5,17.15 43.81,17.15 NOREF#35.3 ; NOREF#41.1 v1(21.59,41.91)
  Bottom Layer w0.254: v1(22.54,39.05) 21.59,40.01 v1(21.59,41.91)
RTS-AT/AD: length 12.6
  Top Layer w0.254: NOREF#11.2 52.34,42.18 44.78,42.18
RTS-RS/AD: length 9.3
  Top Layer w0.254: 39.01,42.21 41.56,42.21 41.9,42.55 41.9,46.34 42.55,46.99 42.55,47.59 43.22,48.26
RTS/AT: length 10.5
  Top Layer w0.254: NOREF#59.1 v1(66.04,43.18) ; v1(60.01,44.13) NOREF#50.2
  Bottom Layer w0.254: v1(66.04,43.18) 60.96,43.18 v1(60.01,44.13)
RTS/RS: length 6.2
  Top Layer w0.254: NOREF#14.2 41.91,52.07 41.91,56.52
RXD-AT/AD: length 14.2
  Top Layer w0.254: NOREF#25.2 55.25,48.26 v1(53.97,46.99) ; v1(52.07,43.82) 51.75,43.49 44.81,43.49
  Bottom Layer w0.254: v1(52.07,43.82) 52.07,45.72 53.34,46.99 v1(53.97,46.99)
RXD-RS/AD: length 7.1
  Top Layer w0.254: v1(43.18,44.13) 45.09,44.13 ; v1(41.28,46.04) 41.28,47.63 NOREF#71.2
  Bottom Layer w0.254: v1(41.28,46.04) v1(43.18,44.13)
RXD/AT: length 18.1
  Top Layer w0.254: NOREF#43.1 v1(68.58,43.18) ; NOREF.2 57.47,47.31 v1(57.47,46.99)
  Bottom Layer w0.254: v1(68.58,43.18) 67.94,42.55 60.64,42.55 58.74,44.45 58.1,44.45 57.15,45.4 57.15,46.04 57.47,46.36 v1(57.47,46.99)
RXD/RS: length 3.1
  Top Layer w0.254: NOREF#20.2 40.41,51.03 RS232C.2
SCLK/AT: length 46.7
  Top Layer w0.254: NOREF#61.1 v1(71.44,22.54) ; NOREF#51.3 37.47,14.61 v1(37.47,15.24)
  Bottom Layer w0.254: v1(71.44,22.54) 65.72,28.26 58.42,28.26 57.15,26.99 57.15,25.08 55.88,23.81 55.88,23.18 51.75,19.05 44.13,19.05 43.5,18.42 41.59,18.42 40.96,17.78 39.05,17.78 38.1,16.83 38.1,16.19 37.47,15.56 v1(37.47,15.24)
SCLK/IC: length 14.3
  Top Layer w0.254: ICSP.3 42.55,3.18 42.23,3.18 41.59,2.54 39.37,2.54 37.47,4.45 37.47,10.8 NOREF#10.3
SCLK/MX: length 39.4
  Top Layer w0.254: v1(28.58,20.96) 28.89,20.96 32.07,17.78 34.61,17.78 35.24,17.15 36.23,17.15 36.74,16.64 ; NOREF#9.1 v1(19.05,38.42)
  Bottom Layer w0.254: v1(19.05,38.42) 21.59,35.88 21.59,24.45 23.81,22.23 27.31,22.23 v1(28.58,20.96)
SS/AT: length 44.8
  Top Layer w0.254: NOREF#19.3 34.93,14.61 v1(34.93,15.24) ; v1(64.77,25.72) 66.36,25.72 69.85,22.23 NOREF#57.1 ; v1(63.5,25.72) 62.87,26.35 62.23,26.35 60.96,25.08 v1(60.33,25.08) ; v1(50.8,20) 51.75,20.96 v1(54.61,20.96)
  Bottom Layer w0.254: v1(50.8,20) 50.48,19.69 44.13,19.69 43.5,19.05 41.59,19.05 40.96,18.42 39.05,18.42 38.42,17.78 36.51,17.78 35.56,16.83 35.56,16.19 34.93,15.56 v1(34.93,15.24) ; v1(60.33,25.08) 59.06,25.08 58.74,25.4 58.1,25.4 56.52,23.81 56.52,22.86 v1(54.61,20.96) ; v1(63.5,25.72) v1(64.77,25.72)
SS/LM: length 7.6
  Top Layer w0.254: 41.28,25.4 42.22,26.35 42.22,31.1 41.85,31.47 40.85,31.47
SS/MX: length 38.4
  Top Layer w0.254: v1(27.62,20.96) 28.26,20.32 28.89,20.32 32.07,17.15 33.66,17.15 NOREF#27.3 ; 16.51,44.36 18.41,42.45 18.41,37.78
  Bottom Layer w0.254: v1(27.62,20.96) 26.99,21.59 23.81,21.59 20.96,24.45 20.96,35.24 v1(18.42,37.78)
SW/LM: length 7.7
  Top Layer w0.254: 44.45,23.5 43.81,24.13 v1(43.81,24.77) ; v1(41.59,29.21) 41.25,29.55 40.9,29.55
  Bottom Layer w0.254: v1(41.59,29.21) 43.81,26.99 v1(43.81,24.77)
TXD-AT/AD: length 16.9
  Top Layer w0.254: 45.04,42.84 52.05,42.84 v1(53.02,43.82) ; NOREF#60.2 v1(54.61,49.53)
  Bottom Layer w0.254: v1(53.02,43.82) 53.66,43.82 54.61,44.77 v1(54.61,49.53)
TXD-RS/AD: length 8.2
  Top Layer w0.254: NOREF#62.2 v1(39.37,46.99) ; 44.83,44.81 43.46,44.81 v1(43.18,45.09)
  Bottom Layer w0.254: v1(39.37,46.99) 39.69,46.67 41.59,46.67 v1(43.18,45.09)
TXD/AT: length 24.3
  Top Layer w0.254: NOREF#18.1 v1(71.12,43.18) ; v1(60.96,41.91) 60.6,41.91 59.69,42.82 59.69,43.5 58.74,44.45 58.1,44.45 57.15,45.4 57.15,46.36 56.83,46.67 56.83,47.31 57.15,47.63 57.15,48.58 57.47,48.9 57.47,49.85 NOREF#56.2
  Bottom Layer w0.254: v1(71.12,43.18) 69.85,41.91 v1(60.96,41.91)
TXD/RS: length 6.6
  Top Layer w0.254: 43.23,53.79 42.55,53.1 v1(42.55,52.71) ; v1(39.37,51.75) 38.42,50.8 NOREF#72.2
  Bottom Layer w0.254: v1(42.55,52.71) 41.91,52.07 39.69,52.07 v1(39.37,51.75)
V+/AD: length 10.7
  Top Layer w0.254: 48.26,45.09 47.31,45.09 v1(46.36,44.13) ; 39.02,45.51 40.85,45.51 v1(41.28,45.09)
  Bottom Layer w0.254: v1(46.36,44.13) 45.72,43.5 42.86,43.5 v1(41.28,45.09)
V-/AD: length 4.9
  Top Layer w0.254: 39.04,42.88 34.59,42.88 34.29,43.18

## Text on the board
Bottom Silkscreen Layer: URADORRY-SUN Rev1.0
Top Silkscreen Layer: USB-D | TXD | RXD | RTS | CTS | RS<->AD | USB / +UHS | JP-RAW | AT<->AD | SERIAL | 7V | GND | +7V | JP-MODE | SS | SCLK | MISO | MOSI | RST | 3.3V | VCC | RAW | D- | D+ | VBUS | ICSP | ATmega32U4 | MAX3421E
